# EasyEDA Pro project Dex_split.eprj, board lets_go (continued)
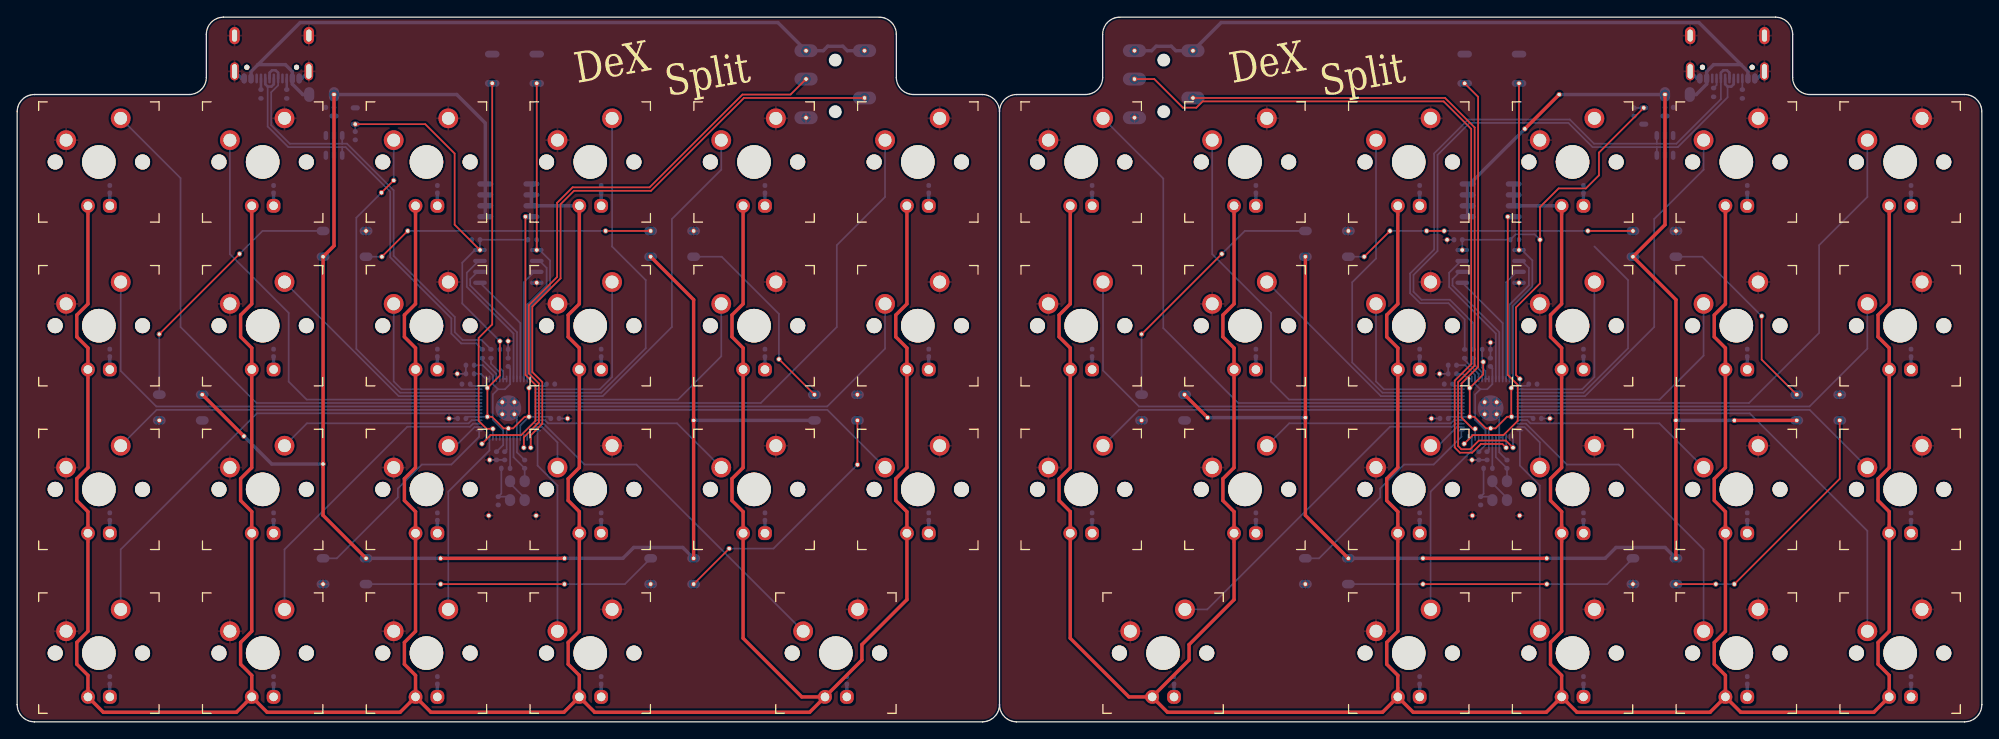
[diagram p0: board, top side]
## Routing (per net, layer and track width the routed paths; a pad name or vN(x,y) marks a point on that pad's centre or on a via; arc(x,y) is an arc through that point) (continued)
LMX5: length 43.1
  Bottom Layer w0.2: U5.4 68.1,37.9 76.15,45.95 76.15,58.52 81.89,64.25 LMX_SW5.5
LMX6: length 62.5
  Bottom Layer w0.2: U5.6 86.48,37.1 95.33,45.94 95.33,55.47 100.94,61.08 LMX_SW6.5
LMX7: length 53.7
  Bottom Layer w0.2: U5.36 16.18,36.7 12.04,40.84 LMX_SW7.4
LMX8: length 28.1
  Bottom Layer w0.2: LMX_SW8.4 44.37,37.9 U5.39
LMX9: length 19.3
  Bottom Layer w0.2: U5.41 44.7,38.7 43.79,39.61 LMX_SW9.5
LMX10: length 20.3
  Bottom Layer w0.2: LMX_SW10.4 69.19,40.12 67.77,38.7 U5.2
LMX11: length 29.6
  Bottom Layer w0.2: LMX_SW11.5 81.89,42.54 76.85,37.5 U5.5
LMX12: length 48.4
  Bottom Layer w0.2: U5.7 94.21,36.7 100.94,43.43 LMX_SW12.5
LMX13: length 43.4
  Bottom Layer w0.2: LMX_SW13.4 16.21,36.3 U5.35
LMX14: length 23.9
  Bottom Layer w0.2: LMX_SW14.4 33.7,34.74 52.5,34.74 52.86,35.1 U5.32
LMX15: length 4.5
  Bottom Layer w0.2: LMX_SW15.4 51.02,32.13 53.19,34.3 U5.30
LMX16: length 6
  Bottom Layer w0.2: U5.13 61.06,34.3 62.84,32.52 LMX_SW16.5
LMX17: length 23.6
  Bottom Layer w0.2: U5.11 61.39,35.1 61.75,34.74 76.74,34.74 LMX_SW17.5
LMX18: length 43.2
  Bottom Layer w0.2: U5.8 94.23,36.3 LMX_SW18.5
LMX19: length 55.2
  Bottom Layer w0.2: U5.34 27.88,35.9 12.04,20.06 LMX_SW19.4
LMX20: length 35.7
  Bottom Layer w0.2: U5.31 53.03,34.7 52.67,34.34 45.37,34.34 31.09,20.06 LMX_SW20.4
LMX21: length 22
  Bottom Layer w0.2: LMX_SW21.4 50.14,26.79 54.92,31.58 U5.27
LMX22: length 24.3
  Bottom Layer w0.2: U5.14 60.53,29.82 62.84,27.5 LMX_SW22.5
LMX23: length 40.9
  Bottom Layer w0.2: U5.12 61.22,34.7 65.98,29.94 72.02,29.94 LMX_SW23.5
LS1: length 68.7
  Top Layer w0.2: NOREF#7.1 NOREF#15.4 ; NOREF#10.1 NOREF#106.4
  Bottom Layer w0.2: NOREF#15.4 70.68,16.03 D4.4 ; NOREF#106.4 184.93,16.03 D10.4 ; D3.2 NOREF#7.1 ; D9.2 NOREF#10.1
LS2: length 60.9
  Top Layer w0.2: NOREF#59.2 211.97,28.28 NOREF#27.1 ; NOREF#19.1 NOREF#134.1 ; NOREF#48.2 NOREF#61.1 ; NOREF#86.1 NOREF#29.1
  Bottom Layer w0.2: NOREF#134.1 87.96,20.16 NOREF#61.1 ; NOREF#29.1 NOREF#59.2
LS3: length 47.4
  Top Layer w0.2: NOREF#4.1 202.9,42.15 NOREF#138.1 ; NOREF#119.1 NOREF#39.1
  Bottom Layer w0.2: NOREF#138.1 195.98,54.12 D12.4 ; NOREF#39.1 88.6,47.47 81.94,54.12 D6.4
LS4: length 68.7
  Top Layer w0.2: NOREF#38.1 NOREF#93.2 ; NOREF#56.1 NOREF#50.2 ; NOREF#109.1 NOREF#66.2 ; NOREF#73.1 NOREF#12.2 ; NOREF#116.1 NOREF#47.2
  Bottom Layer w0.2: NOREF#12.2 NOREF#47.2 ; NOREF#50.2 NOREF#38.1 ; D1.4 NOREF#93.2 ; NOREF#116.1 NOREF#109.1 ; D7.4 NOREF#66.2
LS5: length 62.1
  Top Layer w0.2: NOREF#112.1 NOREF#72.1 ; NOREF#90.1 NOREF#104.1
  Bottom Layer w0.2: NOREF#90.1 28.53,57.12 D1.2 ; D8.4 NOREF#72.1 ; D7.2 142.78,57.12 NOREF#112.1 ; D2.4 NOREF#104.1
NET-(C10-PAD2): length 5
  Bottom Layer w0.2: R6.1 170.56,26.55 C10.2 171.18,26.2 171.57,25.8
NET-(C22-PAD2): length 5
  Bottom Layer w0.2: Y1.1 56.92,26.2 C22.2 56.31,26.56 56.31,29.5
NET-(J9-PADA5): length 2.6
  Bottom Layer w0.2: J2.A5 197.65,74.1 R1.1
  Bottom Layer w0.3: J1.A5 R12.1
NET-(J9-PADB5): length 2.6
  Bottom Layer w0.2: J2.B5 R2.1
  Bottom Layer w0.3: J1.B5 R13.1
QCLK_L: length 15.4
  Bottom Layer w0.2: U4.6 167.79,52.36 166.94,51.52 166.94,50.78 172.38,45.35 U1.52
QCLK_R: length 15.4
  Bottom Layer w0.2: U8.6 53.54,52.36 52.69,51.52 52.69,50.78 58.12,45.35 U5.52
QIO0_L: length 13.1
  Bottom Layer w0.2: U1.53 172.78,46.39 U4.5
QIO0_R: length 13.1
  Bottom Layer w0.2: U8.5 58.53,46.39 U5.53
QIO1_L: length 15.3
  Bottom Layer w0.2: U4.2 175.01,53.64 175.83,52.82 175.83,50.81 173.57,48.56 U1.55
QIO1_R: length 15.3
  Bottom Layer w0.2: U8.2 60.76,53.64 61.58,52.82 61.58,50.81 59.33,48.56 U5.55
QIO2_L: length 13.3
  Bottom Layer w0.2: U1.54 173.18,51.15 174.39,52.36 U4.3
QIO2_R: length 13.3
  Bottom Layer w0.2: U8.3 60.14,52.36 58.92,51.15 U5.54
QIO3_L: length 16.7
  Bottom Layer w0.2: U4.7 167.92,53.64 166.54,52.26 166.54,50.62 171.97,45.18 U1.51
QIO3_R: length 16.7
  Bottom Layer w0.2: U5.51 57.72,45.18 52.29,50.62 52.29,52.26 53.67,53.64 U8.7
QSEL_L: length 37.4
  Top Layer w0.2: NOREF#69.1 174.67,54.91 174.67,74.29 NOREF#96.2
  Bottom Layer w0.2: R8.2 NOREF#69.1 175.01,54.91 176.23,53.69 176.23,50.64 173.97,48.39 U1.56
QSEL_R: length 37.4
  Top Layer w0.2: NOREF#62.1 NOREF#57.1
  Bottom Layer w0.2: R17.2 NOREF#57.1 60.76,54.91 61.98,53.69 61.98,50.64 59.72,48.39 U5.56
R_D+: length 72.2
  Bottom Layer w0.2: 190.69,66.88 190.7,66.87 U3.3 ; 190.69,66.88 193.14,66.88 198.93,72.67 198.93,73.92 ; 190.69,66.88 183.23,66.88 180.42,69.69 168.92,69.69 165.2,65.97 165.2,54.79 162.4,52 162.4,50.04 163.33,49.12 166.63,49.12 169.35,46.4 R4.1
  Bottom Layer w0.3: J2.B6 199.65,74.21 199.37,73.92 198.93,73.92 198.65,74.21 J2.A6
R_D-: length 72.8
  Bottom Layer w0.2: 190.69,67.28 192.98,67.28 198.15,72.45 J2.B7 ; 190.69,67.28 190.7,67.29 U3.4 ; 190.69,67.28 183.4,67.28 180.58,70.09 168.75,70.09 164.8,66.14 164.8,54.96 162,52.17 162,49.88 163.16,48.72 166.47,48.72 168.35,46.83 R5.1
  Bottom Layer w0.3: J2.A7 199.15,75.53 198.87,75.81 198.43,75.81 198.15,75.53 J2.B7
R_USB_DM: length 3.1
  Bottom Layer w0.2: U1.46 169.97,40.49 168.35,42.12 R5.2
R_USB_DP: length 5.4
  Bottom Layer w0.2: 56.12,40.07 56.12,40.66 55.1,41.68 R10.2 ; R4.2 169.35,41.68 170.38,40.66 170.38,40.07
RESET_L: length 43.5
  Top Layer w0.2: NOREF#88.1 169.29,34.1 167.99,35.4 167.99,39.37 169.91,41.29 169.91,72.74 NOREF#71.1
  Bottom Layer w0.2: NOREF#88.1 U1.26
RESET_R: length 43
  Top Layer w0.2: NOREF#6.1 55.25,46.25 53.67,44.67 53.67,35.02 54.59,34.1 NOREF#103.1
  Bottom Layer w0.2: NOREF#103.1 U5.26
RMX1: length 62.9
  Bottom Layer w0.2: RMX_SW1.5 215.19,61.08 209.58,55.47 209.58,45.26 201.42,37.1 U1.6
RMX2: length 43.1
  Bottom Layer w0.2: RMX_SW2.5 196.14,64.25 190.4,58.52 190.4,45.95 182.35,37.9 U1.4
RMX3: length 28.2
  Bottom Layer w0.2: U1.3 182.18,38.3 187.35,43.47 187.35,51.4 183.44,55.31
RMX4: length 41.2
  Bottom Layer w0.2: RMX_SW4.5 158.04,53.92 155.27,51.15 155.27,41.81 158.79,38.3 U1.40
RMX5: length 53.9
  Bottom Layer w0.2: U1.38 147.91,37.5 145.82,39.59 145.82,47.59 138.99,54.43 RMX_SW5.5
RMX6: length 65.6
  Bottom Layer w0.2: U1.37 142.01,37.1 133.3,45.81 133.3,63.22 RMX_SW6.4
RMX7: length 48.4
  Bottom Layer w0.2: U1.7 208.46,36.7 215.19,43.43 RMX_SW7.5
RMX8: length 29.5
  Bottom Layer w0.2: U1.5 191.03,37.5 196.14,42.61 RMX_SW8.5
RMX9: length 20.3
  Bottom Layer w0.2: U1.2 182.01,38.7 183.44,40.12 RMX_SW9.4
RMX10: length 19.3
  Bottom Layer w0.2: U1.41 158.95,38.7 158.04,39.61 RMX_SW10.5
RMX11: length 28.1
  Bottom Layer w0.2: RMX_SW11.4 158.62,37.9 U1.39
RMX12: length 53.7
  Bottom Layer w0.2: RMX_SW12.4 126.29,40.89 130.48,36.7 U1.36
RMX13: length 43.2
  Bottom Layer w0.2: RMX_SW13.5 208.48,36.3 U1.8
RMX14: length 23.6
  Bottom Layer w0.2: RMX_SW14.5 190.99,34.74 176,34.74 175.64,35.1 U1.11
RMX15: length 6
  Bottom Layer w0.2: U1.13 175.31,34.3 177.09,32.52 RMX_SW15.5
RMX16: length 4.5
  Bottom Layer w0.2: RMX_SW16.4 165.27,32.13 167.44,34.3 U1.30
RMX17: length 23.9
  Bottom Layer w0.2: RMX_SW17.4 147.95,34.74 166.75,34.74 167.11,35.1 U1.32
RMX18: length 43.4
  Bottom Layer w0.2: RMX_SW18.4 130.46,36.3 U1.35
RMX19: length 57.8
  Bottom Layer w0.2: U1.9 201.51,35.9 215.19,22.22 RMX_SW19.5
RMX20: length 37
  Bottom Layer w0.2: U1.12 175.47,34.7 180.23,29.94 186.26,29.94 196.14,20.06 RMX_SW20.5
RMX21: length 24.3
  Bottom Layer w0.2: U1.14 174.78,29.82 177.09,27.5 RMX_SW21.5
RMX22: length 22
  Bottom Layer w0.2: RMX_SW22.4 164.39,26.79 169.18,31.58 U1.27
RMX23: length 41.1
  Bottom Layer w0.2: U1.31 167.28,34.7 166.92,34.34 159.67,34.34 138.41,13.08 RMX_SW23.4
RX: length 153
  Top Layer w0.2: NOREF#111.9 166.08,72.6 169.51,69.16 169.51,41.46 167.59,39.53 167.59,32.1 167.97,31.72 168.99,31.72 170,32.73 173.14,32.73 NOREF#42.2 ; NOREF#108.6 84.52,72.6 73.72,61.8 64.76,61.8 63.2,60.24 63.2,51.6 59.91,48.32 59.91,40.7 61.08,39.54 61.08,34.69 59.72,33.34 NOREF#75.2
  Bottom Layer w0.2: NOREF#75.2 U5.15 ; U1.15 NOREF#42.2
TX: length 155.3
  Top Layer w0.2: NOREF#43.1 58.92,33.1 60.67,34.85 60.67,39.38 59.51,40.54 59.51,48.48 62.8,51.77 62.8,60.4 64.59,62.2 73.55,62.2 84.35,73 89.95,73 NOREF#5.7 ; NOREF#65.1 172.74,32.33 170.24,32.33 169.22,31.32 167.81,31.32 167.19,31.93 167.19,39.7 169.11,41.62 169.11,69 165.91,72.2 137.87,72.2 137.14,71.47 135.59,71.47 132.25,74.8 NOREF#18.8
  Bottom Layer w0.2: NOREF#43.1 U5.17 ; NOREF#65.1 U1.17
XIN_L: length 5.6
  Bottom Layer w0.2: U1.20 171.97,30.8 C11.2 Y2.3
XIN_R: length 5.6
  Bottom Layer w0.2: U5.20 57.72,30.8 C21.2 59.03,28
XOUT_L: length 3.6
  Bottom Layer w0.2: U1.21 R6.2
XOUT_R: length 3.6
  Bottom Layer w0.2: U5.21 R16.2

## Copper pours and planes (outline as drawn; the poured copper is in the pictures)
GND on Top Layer: -1.57,84.55 230.58,84.55 230.58,-2.44 -1.57,-2.44
GND on Bottom Layer: -0.43,85.95 228.93,85.95 228.93,-4.1 -0.43,-4.1

Small or netless copper shapes (teardrops, artwork), in the pictures only: 198 on Top Layer, 563 on Bottom Layer

## Text on the board
Bottom Silkscreen Layer: reset | boot
Top Silkscreen Layer: DeX | Split
